# Altium schematic sheet Amps.SchDoc (part 1 of 2) (continued)
## Parts (continued)
C132  value 100nF  [CAPC0603(1608)100_L]  (hidden comment: Capacitor 100nF 0603)
C133  value 100nF  [CAPC0603(1608)100_L]  (hidden comment: Capacitor 100nF 0603)
C134  value 2.2uF  [CAPC0603(1608)100_L]  (hidden comment: Capacitor 2.2uF 0603)
C135  value 2.7nF  [CAPC0603(1608)100_L]  (hidden comment: Capacitor 2.7nF 0603)
C136  value 2.7nF  [CAPC0603(1608)100_L]  (hidden comment: Capacitor 2.7nF 0603)
C137  value 2.7nF  [CAPC0603(1608)100_L]  (hidden comment: Capacitor 2.7nF 0603)
C138  value 2.7nF  [CAPC0603(1608)100_L]  (hidden comment: Capacitor 2.7nF 0603)
C139  value 10µF  [CAPC0805(2012)145_L]  (hidden comment: Capacitor 10µF +/-20% 25V 0805)
C140  value 10µF  [CAPC0805(2012)145_L]  (hidden comment: Capacitor 10µF +/-20% 25V 0805)
C141  value 10µF  [CAPC0805(2012)145_L]  (hidden comment: Capacitor 10µF +/-20% 25V 0805)
C142  value 10µF  [CAPC0805(2012)145_L]  (hidden comment: Capacitor 10µF +/-20% 25V 0805)
C143  value 10µF  [CAPC0805(2012)145_L]  (hidden comment: Capacitor 10µF +/-20% 25V 0805)
C144  value 10µF  [CAPC0805(2012)145_L]  (hidden comment: Capacitor 10µF +/-20% 25V 0805)
C145  value 10µF  [CAPC0805(2012)145_L]  (hidden comment: Capacitor 10µF +/-20% 25V 0805)
C146  value 10µF  [CAPC0805(2012)145_L]  (hidden comment: Capacitor 10µF +/-20% 25V 0805)
C147  value 47nF  [CAPC0603(1608)100_L]  (hidden comment: Capacitor 47nF 0603)
C148  value 47nF  [CAPC0603(1608)100_L]  (hidden comment: Capacitor 47nF 0603)
C149  value 47nF  [CAPC0603(1608)100_L]  (hidden comment: Capacitor 47nF 0603)
C150  value 47nF  [CAPC0603(1608)100_L]  (hidden comment: Capacitor 47nF 0603)
C151  value 47nF  [CAPC0603(1608)100_L]  (hidden comment: Capacitor 47nF 0603)
C152  value 47nF  [CAPC0603(1608)100_L]  (hidden comment: Capacitor 47nF 0603)
C153  value 47nF  [CAPC0603(1608)100_L]  (hidden comment: Capacitor 47nF 0603)
C154  value 47nF  [CAPC0603(1608)100_L]  (hidden comment: Capacitor 47nF 0603)
C155  value 2.2uF  [CAPC0603(1608)100_L]  (hidden comment: Capacitor 2.2uF 0603)
C156  value 100nF  [CAPC0603(1608)100_L]  (hidden comment: Capacitor 100nF 0603)
C157  value 100nF  [CAPC0603(1608)100_L]  (hidden comment: Capacitor 100nF 0603)
C158  value 2.2uF  [CAPC0603(1608)100_L]  (hidden comment: Capacitor 2.2uF 0603)
C159  value 2.7nF  [CAPC0603(1608)100_L]  (hidden comment: Capacitor 2.7nF 0603)
C160  value 2.7nF  [CAPC0603(1608)100_L]  (hidden comment: Capacitor 2.7nF 0603)
C161  value 2.7nF  [CAPC0603(1608)100_L]  (hidden comment: Capacitor 2.7nF 0603)
C162  value 2.7nF  [CAPC0603(1608)100_L]  (hidden comment: Capacitor 2.7nF 0603)
C163  value 10µF  [CAPC0805(2012)145_L]  (hidden comment: Capacitor 10µF +/-20% 25V 0805)
C164  value 10µF  [CAPC0805(2012)145_L]  (hidden comment: Capacitor 10µF +/-20% 25V 0805)
C165  value 10µF  [CAPC0805(2012)145_L]  (hidden comment: Capacitor 10µF +/-20% 25V 0805)
C166  value 10µF  [CAPC0805(2012)145_L]  (hidden comment: Capacitor 10µF +/-20% 25V 0805)
C167  value 10µF  [CAPC0805(2012)145_L]  (hidden comment: Capacitor 10µF +/-20% 25V 0805)
C168  value 10µF  [CAPC0805(2012)145_L]  (hidden comment: Capacitor 10µF +/-20% 25V 0805)
C169  value 10µF  [CAPC0805(2012)145_L]  (hidden comment: Capacitor 10µF +/-20% 25V 0805)
C170  value 10µF  [CAPC0805(2012)145_L]  (hidden comment: Capacitor 10µF +/-20% 25V 0805)
C171  value 47nF  [CAPC0603(1608)100_L]  (hidden comment: Capacitor 47nF 0603)
C172  value 47nF  [CAPC0603(1608)100_L]  (hidden comment: Capacitor 47nF 0603)
C173  value 47nF  [CAPC0603(1608)100_L]  (hidden comment: Capacitor 47nF 0603)
C174  value 47nF  [CAPC0603(1608)100_L]  (hidden comment: Capacitor 47nF 0603)
C175  value 47nF  [CAPC0603(1608)100_L]  (hidden comment: Capacitor 47nF 0603)
C176  value 47nF  [CAPC0603(1608)100_L]  (hidden comment: Capacitor 47nF 0603)
C177  value 47nF  [CAPC0603(1608)100_L]  (hidden comment: Capacitor 47nF 0603)
C178  value 47nF  [CAPC0603(1608)100_L]  (hidden comment: Capacitor 47nF 0603)
C179  value 2.2uF  [CAPC0603(1608)100_L]  (hidden comment: Capacitor 2.2uF 0603)
C180  value 100nF  [CAPC0603(1608)100_L]  (hidden comment: Capacitor 100nF 0603)
C181  value 100nF  [CAPC0603(1608)100_L]  (hidden comment: Capacitor 100nF 0603)
C182  value 2.2uF  [CAPC0603(1608)100_L]  (hidden comment: Capacitor 2.2uF 0603)
C183  value 2.7nF  [CAPC0603(1608)100_L]  (hidden comment: Capacitor 2.7nF 0603)
C184  value 2.7nF  [CAPC0603(1608)100_L]  (hidden comment: Capacitor 2.7nF 0603)
C185  value 2.7nF  [CAPC0603(1608)100_L]  (hidden comment: Capacitor 2.7nF 0603)
C186  value 2.7nF  [CAPC0603(1608)100_L]  (hidden comment: Capacitor 2.7nF 0603)
C187  value 10µF  [CAPC0805(2012)145_L]  (hidden comment: Capacitor 10µF +/-20% 25V 0805)
C188  value 10µF  [CAPC0805(2012)145_L]  (hidden comment: Capacitor 10µF +/-20% 25V 0805)
C189  value 10µF  [CAPC0805(2012)145_L]  (hidden comment: Capacitor 10µF +/-20% 25V 0805)
C190  value 10µF  [CAPC0805(2012)145_L]  (hidden comment: Capacitor 10µF +/-20% 25V 0805)
C191  value 10µF  [CAPC0805(2012)145_L]  (hidden comment: Capacitor 10µF +/-20% 25V 0805)
C192  value 10µF  [CAPC0805(2012)145_L]  (hidden comment: Capacitor 10µF +/-20% 25V 0805)
C193  value 10µF  [CAPC0805(2012)145_L]  (hidden comment: Capacitor 10µF +/-20% 25V 0805)
C194  value 10µF  [CAPC0805(2012)145_L]  (hidden comment: Capacitor 10µF +/-20% 25V 0805)
C195  value 47nF  [CAPC0603(1608)100_L]  (hidden comment: Capacitor 47nF 0603)
C196  value 47nF  [CAPC0603(1608)100_L]  (hidden comment: Capacitor 47nF 0603)
C197  value 47nF  [CAPC0603(1608)100_L]  (hidden comment: Capacitor 47nF 0603)
C198  value 47nF  [CAPC0603(1608)100_L]  (hidden comment: Capacitor 47nF 0603)
C199  value 47nF  [CAPC0603(1608)100_L]  (hidden comment: Capacitor 47nF 0603)
C200  value 47nF  [CAPC0603(1608)100_L]  (hidden comment: Capacitor 47nF 0603)
C201  value 47nF  [CAPC0603(1608)100_L]  (hidden comment: Capacitor 47nF 0603)
C202  value 47nF  [CAPC0603(1608)100_L]  (hidden comment: Capacitor 47nF 0603)
C203  value 2.2uF  [CAPC0603(1608)100_L]  (hidden comment: Capacitor 2.2uF 0603)
C204  value 100nF  [CAPC0603(1608)100_L]  (hidden comment: Capacitor 100nF 0603)
C205  value 100nF  [CAPC0603(1608)100_L]  (hidden comment: Capacitor 100nF 0603)
C206  value 2.2uF  [CAPC0603(1608)100_L]  (hidden comment: Capacitor 2.2uF 0603)
C207  value 2.7nF  [CAPC0603(1608)100_L]  (hidden comment: Capacitor 2.7nF 0603)
C208  value 2.7nF  [CAPC0603(1608)100_L]  (hidden comment: Capacitor 2.7nF 0603)
C209  value 2.7nF  [CAPC0603(1608)100_L]  (hidden comment: Capacitor 2.7nF 0603)
C210  value 2.7nF  [CAPC0603(1608)100_L]  (hidden comment: Capacitor 2.7nF 0603)
C211  value 10µF  [CAPC0805(2012)145_L]  (hidden comment: Capacitor 10µF +/-20% 25V 0805)
C212  value 10µF  [CAPC0805(2012)145_L]  (hidden comment: Capacitor 10µF +/-20% 25V 0805)
C213  value 10µF  [CAPC0805(2012)145_L]  (hidden comment: Capacitor 10µF +/-20% 25V 0805)
C214  value 10µF  [CAPC0805(2012)145_L]  (hidden comment: Capacitor 10µF +/-20% 25V 0805)
C215  value 10µF  [CAPC0805(2012)145_L]  (hidden comment: Capacitor 10µF +/-20% 25V 0805)
C216  value 10µF  [CAPC0805(2012)145_L]  (hidden comment: Capacitor 10µF +/-20% 25V 0805)
C217  value 10µF  [CAPC0805(2012)145_L]  (hidden comment: Capacitor 10µF +/-20% 25V 0805)
C218  value 10µF  [CAPC0805(2012)145_L]  (hidden comment: Capacitor 10µF +/-20% 25V 0805)
C219  value 47nF  [CAPC0603(1608)100_L]  (hidden comment: Capacitor 47nF 0603)
C220  value 47nF  [CAPC0603(1608)100_L]  (hidden comment: Capacitor 47nF 0603)
C221  value 47nF  [CAPC0603(1608)100_L]  (hidden comment: Capacitor 47nF 0603)
C222  value 47nF  [CAPC0603(1608)100_L]  (hidden comment: Capacitor 47nF 0603)
C223  value 47nF  [CAPC0603(1608)100_L]  (hidden comment: Capacitor 47nF 0603)
C224  value 47nF  [CAPC0603(1608)100_L]  (hidden comment: Capacitor 47nF 0603)
C225  value 47nF  [CAPC0603(1608)100_L]  (hidden comment: Capacitor 47nF 0603)
C226  value 47nF  [CAPC0603(1608)100_L]  (hidden comment: Capacitor 47nF 0603)
C227  value 2.2uF  [CAPC0603(1608)100_L]  (hidden comment: Capacitor 2.2uF 0603)
C228  value 100nF  [CAPC0603(1608)100_L]  (hidden comment: Capacitor 100nF 0603)
C229  value 100nF  [CAPC0603(1608)100_L]  (hidden comment: Capacitor 100nF 0603)
C230  value 2.2uF  [CAPC0603(1608)100_L]  (hidden comment: Capacitor 2.2uF 0603)
D1  1N4007  [FAIR-DO-41-2]
D2  1N4007  [FAIR-DO-41-2]
D3  1N4007  [FAIR-DO-41-2]
D4  1N4007  [FAIR-DO-41-2]
D5  1N4007  [FAIR-DO-41-2]
D6  1N4007  [FAIR-DO-41-2]
D7  1N4007  [FAIR-DO-41-2]
D8  1N4007  [FAIR-DO-41-2]
D9  1N4007  [FAIR-DO-41-2]
D10  1N4007  [FAIR-DO-41-2]
D11  1N4007  [FAIR-DO-41-2]
D12  1N4007  [FAIR-DO-41-2]
D13  1N4007  [FAIR-DO-41-2]
D14  1N4007  [FAIR-DO-41-2]
D15  1N4007  [FAIR-DO-41-2]
D16  1N4007  [FAIR-DO-41-2]
D17  1N4007  [FAIR-DO-41-2]
D18  1N4007  [FAIR-DO-41-2]
D19  1N4007  [FAIR-DO-41-2]
D20  1N4007  [FAIR-DO-41-2]
D21  1N4007  [FAIR-DO-41-2]
D22  1N4007  [FAIR-DO-41-2]
D23  1N4007  [FAIR-DO-41-2]
D24  1N4007  [FAIR-DO-41-2]
D25  1N4007  [FAIR-DO-41-2]
D26  1N4007  [FAIR-DO-41-2]
D27  1N4007  [FAIR-DO-41-2]
D28  1N4007  [FAIR-DO-41-2]
D29  1N4007  [FAIR-DO-41-2]
D30  1N4007  [FAIR-DO-41-2]
D31  1N4007  [FAIR-DO-41-2]
D32  1N4007  [FAIR-DO-41-2]
D33  1N4007  [FAIR-DO-41-2]
D34  1N4007  [FAIR-DO-41-2]
D35  1N4007  [FAIR-DO-41-2]
D36  1N4007  [FAIR-DO-41-2]
D37  1N4007  [FAIR-DO-41-2]
D38  1N4007  [FAIR-DO-41-2]
D39  1N4007  [FAIR-DO-41-2]
D40  1N4007  [FAIR-DO-41-2]
D41  1N4007  [FAIR-DO-41-2]
D42  1N4007  [FAIR-DO-41-2]
D43  1N4007  [FAIR-DO-41-2]
D44  1N4007  [FAIR-DO-41-2]
D45  1N4007  [FAIR-DO-41-2]
D46  1N4007  [FAIR-DO-41-2]
D47  1N4007  [FAIR-DO-41-2]
D48  1N4007  [FAIR-DO-41-2]
D49  1N4007  [FAIR-DO-41-2]
D50  1N4007  [FAIR-DO-41-2]
D51  1N4007  [FAIR-DO-41-2]
D52  1N4007  [FAIR-DO-41-2]
D53  1N4007  [FAIR-DO-41-2]
D54  1N4007  [FAIR-DO-41-2]
D55  1N4007  [FAIR-DO-41-2]
D56  1N4007  [FAIR-DO-41-2]
D57  1N4007  [FAIR-DO-41-2]
D58  1N4007  [FAIR-DO-41-2]
D59  1N4007  [FAIR-DO-41-2]
D60  1N4007  [FAIR-DO-41-2]
D61  1N4007  [FAIR-DO-41-2]
D62  1N4007  [FAIR-DO-41-2]
D63  1N4007  [FAIR-DO-41-2]
D64  1N4007  [FAIR-DO-41-2]
Q3  S9013  [JSCJ-TO-92-3_V]
Q4  S8550  [UNIC-TO-92-3]
Q5  S9013  [JSCJ-TO-92-3_V]
Q6  S8550  [UNIC-TO-92-3]
Q7  S9013  [JSCJ-TO-92-3_V]
Q8  S8550  [UNIC-TO-92-3]
Q9  S9013  [JSCJ-TO-92-3_V]
Q10  S8550  [UNIC-TO-92-3]
Q11  S9013  [JSCJ-TO-92-3_V]
Q12  S8550  [UNIC-TO-92-3]
Q13  S9013  [JSCJ-TO-92-3_V]
Q14  S8550  [UNIC-TO-92-3]
Q15  S9013  [JSCJ-TO-92-3_V]
Q16  S8550  [UNIC-TO-92-3]
Q17  S9013  [JSCJ-TO-92-3_V]
Q18  S8550  [UNIC-TO-92-3]
Q19  S9013  [JSCJ-TO-92-3_V]
Q20  S8550  [UNIC-TO-92-3]
Q21  S9013  [JSCJ-TO-92-3_V]
Q22  S8550  [UNIC-TO-92-3]
Q23  S9013  [JSCJ-TO-92-3_V]
Q24  S8550  [UNIC-TO-92-3]
Q25  S9013  [JSCJ-TO-92-3_V]
Q26  S8550  [UNIC-TO-92-3]
Q27  S9013  [JSCJ-TO-92-3_V]
Q28  S8550  [UNIC-TO-92-3]
Q29  S9013  [JSCJ-TO-92-3_V]
Q30  S8550  [UNIC-TO-92-3]
Q31  S9013  [JSCJ-TO-92-3_V]
Q32  S8550  [UNIC-TO-92-3]
Q33  S9013  [JSCJ-TO-92-3_V]
Q34  S8550  [UNIC-TO-92-3]
Q35  S9013  [JSCJ-TO-92-3_V]
Q36  S8550  [UNIC-TO-92-3]
Q37  S9013  [JSCJ-TO-92-3_V]
Q38  S8550  [UNIC-TO-92-3]
Q39  S9013  [JSCJ-TO-92-3_V]
Q40  S8550  [UNIC-TO-92-3]
Q41  S9013  [JSCJ-TO-92-3_V]
Q42  S8550  [UNIC-TO-92-3]
Q43  S9013  [JSCJ-TO-92-3_V]
Q44  S8550  [UNIC-TO-92-3]
Q45  S9013  [JSCJ-TO-92-3_V]
Q46  S8550  [UNIC-TO-92-3]
Q47  S9013  [JSCJ-TO-92-3_V]
Q48  S8550  [UNIC-TO-92-3]
Q49  S9013  [JSCJ-TO-92-3_V]
Q50  S8550  [UNIC-TO-92-3]
Q51  S9013  [JSCJ-TO-92-3_V]
Q52  S8550  [UNIC-TO-92-3]
Q53  S9013  [JSCJ-TO-92-3_V]
Q54  S8550  [UNIC-TO-92-3]
Q55  S9013  [JSCJ-TO-92-3_V]
Q56  S8550  [UNIC-TO-92-3]
Q57  S9013  [JSCJ-TO-92-3_V]
Q58  S8550  [UNIC-TO-92-3]
Q59  S9013  [JSCJ-TO-92-3_V]
Q60  S8550  [UNIC-TO-92-3]
Q61  S9013  [JSCJ-TO-92-3_V]
Q62  S8550  [UNIC-TO-92-3]
Q63  S9013  [JSCJ-TO-92-3_V]
Q64  S8550  [UNIC-TO-92-3]
Q65  S9013  [JSCJ-TO-92-3_V]
Q66  S8550  [UNIC-TO-92-3]
R25  237  [RESC0603(1608)_L]
R26  237  [RESC0603(1608)_L]
R27  237  [RESC0603(1608)_L]
R28  237  [RESC0603(1608)_L]
R29  237  [RESC0603(1608)_L]
R30  237  [RESC0603(1608)_L]
R31  237  [RESC0603(1608)_L]
R32  237  [RESC0603(1608)_L]
R33  value 49.9k  [RESC0603(1608)_L]  (hidden comment: 49.9k Ohm 0603)
R34  value 49.9k  [RESC0603(1608)_L]  (hidden comment: 49.9k Ohm 0603)
R35  value 49.9k  [RESC0603(1608)_L]  (hidden comment: 49.9k Ohm 0603)
R36  value 49.9k  [RESC0603(1608)_L]  (hidden comment: 49.9k Ohm 0603)
R37  value 49.9k  [RESC0603(1608)_L]  (hidden comment: 49.9k Ohm 0603)
R38  value 49.9k  [RESC0603(1608)_L]  (hidden comment: 49.9k Ohm 0603)
R39  value 49.9k  [RESC0603(1608)_L]  (hidden comment: 49.9k Ohm 0603)
R40  value 49.9k  [RESC0603(1608)_L]  (hidden comment: 49.9k Ohm 0603)
R41  value 6.6k  [RESC0603(1608)_L]  (hidden comment: 6.6k 0603)
R42  value 6.6k  [RESC0603(1608)_L]  (hidden comment: 6.6k 0603)
R43  value 6.6k  [RESC0603(1608)_L]  (hidden comment: 6.6k 0603)
R44  value 6.6k  [RESC0603(1608)_L]  (hidden comment: 6.6k 0603)
R45  value 6.6k  [RESC0603(1608)_L]  (hidden comment: 6.6k 0603)
R46  value 6.6k  [RESC0603(1608)_L]  (hidden comment: 6.6k 0603)
R47  value 6.6k  [RESC0603(1608)_L]  (hidden comment: 6.6k 0603)
R48  value 6.6k  [RESC0603(1608)_L]  (hidden comment: 6.6k 0603)
R49  value 1k  [RESC0603(1608)_L]  (hidden comment: 1k 0603)
R50  value 1k  [RESC0603(1608)_L]  (hidden comment: 1k 0603)
R51  value 1k  [RESC0603(1608)_L]  (hidden comment: 1k 0603)
R52  value 1k  [RESC0603(1608)_L]  (hidden comment: 1k 0603)
R53  value 2k  [RESC0603(1608)_L]  (hidden comment: 2k 0603)
R54  value 2k  [RESC0603(1608)_L]  (hidden comment: 2k 0603)
R55  value 2k  [RESC0603(1608)_L]  (hidden comment: 2k 0603)
R56  value 2k  [RESC0603(1608)_L]  (hidden comment: 2k 0603)
R57  value 1k  [RESC0603(1608)_L]  (hidden comment: 1k 0603)
R58  value 1k  [RESC0603(1608)_L]  (hidden comment: 1k 0603)
R59  value 1k  [RESC0603(1608)_L]  (hidden comment: 1k 0603)
R60  value 1k  [RESC0603(1608)_L]  (hidden comment: 1k 0603)
R61  value 2k  [RESC0603(1608)_L]  (hidden comment: 2k 0603)
R62  value 2k  [RESC0603(1608)_L]  (hidden comment: 2k 0603)
R63  value 2k  [RESC0603(1608)_L]  (hidden comment: 2k 0603)
R64  value 2k  [RESC0603(1608)_L]  (hidden comment: 2k 0603)
R65  value 560  [RESC0603(1608)_L]  (hidden comment: 560 0603)
R66  value 560  [RESC0603(1608)_L]  (hidden comment: 560 0603)
R67  value 560  [RESC0603(1608)_L]  (hidden comment: 560 0603)
R68  value 560  [RESC0603(1608)_L]  (hidden comment: 560 0603)
R69  value 560  [RESC0603(1608)_L]  (hidden comment: 560 0603)
R70  value 560  [RESC0603(1608)_L]  (hidden comment: 560 0603)
R71  value 560  [RESC0603(1608)_L]  (hidden comment: 560 0603)
R72  value 560  [RESC0603(1608)_L]  (hidden comment: 560 0603)
R73  237  [RESC0603(1608)_L]
R74  237  [RESC0603(1608)_L]
R75  237  [RESC0603(1608)_L]
R76  237  [RESC0603(1608)_L]
R77  237  [RESC0603(1608)_L]
R78  237  [RESC0603(1608)_L]
R79  237  [RESC0603(1608)_L]
R80  237  [RESC0603(1608)_L]
R81  value 49.9k  [RESC0603(1608)_L]  (hidden comment: 49.9k Ohm 0603)
R82  value 49.9k  [RESC0603(1608)_L]  (hidden comment: 49.9k Ohm 0603)
R83  value 49.9k  [RESC0603(1608)_L]  (hidden comment: 49.9k Ohm 0603)
R84  value 49.9k  [RESC0603(1608)_L]  (hidden comment: 49.9k Ohm 0603)
R85  value 49.9k  [RESC0603(1608)_L]  (hidden comment: 49.9k Ohm 0603)
R86  value 49.9k  [RESC0603(1608)_L]  (hidden comment: 49.9k Ohm 0603)
R87  value 49.9k  [RESC0603(1608)_L]  (hidden comment: 49.9k Ohm 0603)
R88  value 49.9k  [RESC0603(1608)_L]  (hidden comment: 49.9k Ohm 0603)
R89  value 6.6k  [RESC0603(1608)_L]  (hidden comment: 6.6k 0603)
R90  value 6.6k  [RESC0603(1608)_L]  (hidden comment: 6.6k 0603)
R91  value 6.6k  [RESC0603(1608)_L]  (hidden comment: 6.6k 0603)
R92  value 6.6k  [RESC0603(1608)_L]  (hidden comment: 6.6k 0603)
R93  value 6.6k  [RESC0603(1608)_L]  (hidden comment: 6.6k 0603)
R94  value 6.6k  [RESC0603(1608)_L]  (hidden comment: 6.6k 0603)
R95  value 6.6k  [RESC0603(1608)_L]  (hidden comment: 6.6k 0603)
R96  value 6.6k  [RESC0603(1608)_L]  (hidden comment: 6.6k 0603)
R97  value 1k  [RESC0603(1608)_L]  (hidden comment: 1k 0603)
R98  value 1k  [RESC0603(1608)_L]  (hidden comment: 1k 0603)
R99  value 1k  [RESC0603(1608)_L]  (hidden comment: 1k 0603)
R100  value 1k  [RESC0603(1608)_L]  (hidden comment: 1k 0603)
R101  value 2k  [RESC0603(1608)_L]  (hidden comment: 2k 0603)
R102  value 2k  [RESC0603(1608)_L]  (hidden comment: 2k 0603)
R103  value 2k  [RESC0603(1608)_L]  (hidden comment: 2k 0603)
R104  value 2k  [RESC0603(1608)_L]  (hidden comment: 2k 0603)
R105  value 1k  [RESC0603(1608)_L]  (hidden comment: 1k 0603)
R106  value 1k  [RESC0603(1608)_L]  (hidden comment: 1k 0603)
R107  value 1k  [RESC0603(1608)_L]  (hidden comment: 1k 0603)
R108  value 1k  [RESC0603(1608)_L]  (hidden comment: 1k 0603)
R109  value 2k  [RESC0603(1608)_L]  (hidden comment: 2k 0603)
R110  value 2k  [RESC0603(1608)_L]  (hidden comment: 2k 0603)
R111  value 2k  [RESC0603(1608)_L]  (hidden comment: 2k 0603)
R112  value 2k  [RESC0603(1608)_L]  (hidden comment: 2k 0603)
R113  value 560  [RESC0603(1608)_L]  (hidden comment: 560 0603)
R114  value 560  [RESC0603(1608)_L]  (hidden comment: 560 0603)
R115  value 560  [RESC0603(1608)_L]  (hidden comment: 560 0603)
R116  value 560  [RESC0603(1608)_L]  (hidden comment: 560 0603)
R117  value 560  [RESC0603(1608)_L]  (hidden comment: 560 0603)
R118  value 560  [RESC0603(1608)_L]  (hidden comment: 560 0603)
R119  value 560  [RESC0603(1608)_L]  (hidden comment: 560 0603)
R120  value 560  [RESC0603(1608)_L]  (hidden comment: 560 0603)
R121  237  [RESC0603(1608)_L]
R122  237  [RESC0603(1608)_L]
R123  237  [RESC0603(1608)_L]
R124  237  [RESC0603(1608)_L]
R125  237  [RESC0603(1608)_L]
R126  237  [RESC0603(1608)_L]
R127  237  [RESC0603(1608)_L]
R128  237  [RESC0603(1608)_L]
R129  value 49.9k  [RESC0603(1608)_L]  (hidden comment: 49.9k Ohm 0603)
R130  value 49.9k  [RESC0603(1608)_L]  (hidden comment: 49.9k Ohm 0603)
R131  value 49.9k  [RESC0603(1608)_L]  (hidden comment: 49.9k Ohm 0603)
R132  value 49.9k  [RESC0603(1608)_L]  (hidden comment: 49.9k Ohm 0603)
R133  value 49.9k  [RESC0603(1608)_L]  (hidden comment: 49.9k Ohm 0603)
R134  value 49.9k  [RESC0603(1608)_L]  (hidden comment: 49.9k Ohm 0603)
R135  value 49.9k  [RESC0603(1608)_L]  (hidden comment: 49.9k Ohm 0603)
R136  value 49.9k  [RESC0603(1608)_L]  (hidden comment: 49.9k Ohm 0603)
R137  value 6.6k  [RESC0603(1608)_L]  (hidden comment: 6.6k 0603)
R138  value 6.6k  [RESC0603(1608)_L]  (hidden comment: 6.6k 0603)
R139  value 6.6k  [RESC0603(1608)_L]  (hidden comment: 6.6k 0603)
R140  value 6.6k  [RESC0603(1608)_L]  (hidden comment: 6.6k 0603)
R141  value 6.6k  [RESC0603(1608)_L]  (hidden comment: 6.6k 0603)
R142  value 6.6k  [RESC0603(1608)_L]  (hidden comment: 6.6k 0603)
R143  value 6.6k  [RESC0603(1608)_L]  (hidden comment: 6.6k 0603)
R144  value 6.6k  [RESC0603(1608)_L]  (hidden comment: 6.6k 0603)
R145  value 1k  [RESC0603(1608)_L]  (hidden comment: 1k 0603)
R146  value 1k  [RESC0603(1608)_L]  (hidden comment: 1k 0603)
R147  value 1k  [RESC0603(1608)_L]  (hidden comment: 1k 0603)
R148  value 1k  [RESC0603(1608)_L]  (hidden comment: 1k 0603)
R149  value 2k  [RESC0603(1608)_L]  (hidden comment: 2k 0603)
R150  value 2k  [RESC0603(1608)_L]  (hidden comment: 2k 0603)
R151  value 2k  [RESC0603(1608)_L]  (hidden comment: 2k 0603)
R152  value 2k  [RESC0603(1608)_L]  (hidden comment: 2k 0603)
R153  value 1k  [RESC0603(1608)_L]  (hidden comment: 1k 0603)
R154  value 1k  [RESC0603(1608)_L]  (hidden comment: 1k 0603)
R155  value 1k  [RESC0603(1608)_L]  (hidden comment: 1k 0603)
R156  value 1k  [RESC0603(1608)_L]  (hidden comment: 1k 0603)
R157  value 2k  [RESC0603(1608)_L]  (hidden comment: 2k 0603)
R158  value 2k  [RESC0603(1608)_L]  (hidden comment: 2k 0603)
R159  value 2k  [RESC0603(1608)_L]  (hidden comment: 2k 0603)
R160  value 2k  [RESC0603(1608)_L]  (hidden comment: 2k 0603)
R161  value 560  [RESC0603(1608)_L]  (hidden comment: 560 0603)
R162  value 560  [RESC0603(1608)_L]  (hidden comment: 560 0603)
R163  value 560  [RESC0603(1608)_L]  (hidden comment: 560 0603)
R164  value 560  [RESC0603(1608)_L]  (hidden comment: 560 0603)
R165  value 560  [RESC0603(1608)_L]  (hidden comment: 560 0603)
R166  value 560  [RESC0603(1608)_L]  (hidden comment: 560 0603)
R167  value 560  [RESC0603(1608)_L]  (hidden comment: 560 0603)
R168  value 560  [RESC0603(1608)_L]  (hidden comment: 560 0603)
R169  237  [RESC0603(1608)_L]
R170  237  [RESC0603(1608)_L]
R171  237  [RESC0603(1608)_L]
R172  237  [RESC0603(1608)_L]
R173  237  [RESC0603(1608)_L]
R174  237  [RESC0603(1608)_L]
R175  237  [RESC0603(1608)_L]
R176  237  [RESC0603(1608)_L]
R177  value 49.9k  [RESC0603(1608)_L]  (hidden comment: 49.9k Ohm 0603)
R178  value 49.9k  [RESC0603(1608)_L]  (hidden comment: 49.9k Ohm 0603)
R179  value 49.9k  [RESC0603(1608)_L]  (hidden comment: 49.9k Ohm 0603)
R180  value 49.9k  [RESC0603(1608)_L]  (hidden comment: 49.9k Ohm 0603)
R181  value 49.9k  [RESC0603(1608)_L]  (hidden comment: 49.9k Ohm 0603)
R182  value 49.9k  [RESC0603(1608)_L]  (hidden comment: 49.9k Ohm 0603)
R183  value 49.9k  [RESC0603(1608)_L]  (hidden comment: 49.9k Ohm 0603)
R184  value 49.9k  [RESC0603(1608)_L]  (hidden comment: 49.9k Ohm 0603)
R185  value 6.6k  [RESC0603(1608)_L]  (hidden comment: 6.6k 0603)
R186  value 6.6k  [RESC0603(1608)_L]  (hidden comment: 6.6k 0603)
R187  value 6.6k  [RESC0603(1608)_L]  (hidden comment: 6.6k 0603)
R188  value 6.6k  [RESC0603(1608)_L]  (hidden comment: 6.6k 0603)
R189  value 6.6k  [RESC0603(1608)_L]  (hidden comment: 6.6k 0603)
R190  value 6.6k  [RESC0603(1608)_L]  (hidden comment: 6.6k 0603)
R191  value 6.6k  [RESC0603(1608)_L]  (hidden comment: 6.6k 0603)
R192  value 6.6k  [RESC0603(1608)_L]  (hidden comment: 6.6k 0603)
R193  value 1k  [RESC0603(1608)_L]  (hidden comment: 1k 0603)
R194  value 1k  [RESC0603(1608)_L]  (hidden comment: 1k 0603)
R195  value 1k  [RESC0603(1608)_L]  (hidden comment: 1k 0603)
R196  value 1k  [RESC0603(1608)_L]  (hidden comment: 1k 0603)
R197  value 2k  [RESC0603(1608)_L]  (hidden comment: 2k 0603)
R198  value 2k  [RESC0603(1608)_L]  (hidden comment: 2k 0603)
R199  value 2k  [RESC0603(1608)_L]  (hidden comment: 2k 0603)
R200  value 2k  [RESC0603(1608)_L]  (hidden comment: 2k 0603)
R201  value 1k  [RESC0603(1608)_L]  (hidden comment: 1k 0603)
R202  value 1k  [RESC0603(1608)_L]  (hidden comment: 1k 0603)
R203  value 1k  [RESC0603(1608)_L]  (hidden comment: 1k 0603)
R204  value 1k  [RESC0603(1608)_L]  (hidden comment: 1k 0603)
R205  value 2k  [RESC0603(1608)_L]  (hidden comment: 2k 0603)
R206  value 2k  [RESC0603(1608)_L]  (hidden comment: 2k 0603)
R207  value 2k  [RESC0603(1608)_L]  (hidden comment: 2k 0603)
R208  value 2k  [RESC0603(1608)_L]  (hidden comment: 2k 0603)
R209  value 560  [RESC0603(1608)_L]  (hidden comment: 560 0603)
R210  value 560  [RESC0603(1608)_L]  (hidden comment: 560 0603)
R211  value 560  [RESC0603(1608)_L]  (hidden comment: 560 0603)
R212  value 560  [RESC0603(1608)_L]  (hidden comment: 560 0603)
R213  value 560  [RESC0603(1608)_L]  (hidden comment: 560 0603)
R214  value 560  [RESC0603(1608)_L]  (hidden comment: 560 0603)
R215  value 560  [RESC0603(1608)_L]  (hidden comment: 560 0603)
R216  value 560  [RESC0603(1608)_L]  (hidden comment: 560 0603)
R217  237  [RESC0603(1608)_L]
R218  237  [RESC0603(1608)_L]
R219  237  [RESC0603(1608)_L]
R220  237  [RESC0603(1608)_L]
R221  237  [RESC0603(1608)_L]
R222  237  [RESC0603(1608)_L]
R223  237  [RESC0603(1608)_L]
R224  237  [RESC0603(1608)_L]
R225  value 49.9k  [RESC0603(1608)_L]  (hidden comment: 49.9k Ohm 0603)
R226  value 49.9k  [RESC0603(1608)_L]  (hidden comment: 49.9k Ohm 0603)
R227  value 49.9k  [RESC0603(1608)_L]  (hidden comment: 49.9k Ohm 0603)
R228  value 49.9k  [RESC0603(1608)_L]  (hidden comment: 49.9k Ohm 0603)
R229  value 49.9k  [RESC0603(1608)_L]  (hidden comment: 49.9k Ohm 0603)
R230  value 49.9k  [RESC0603(1608)_L]  (hidden comment: 49.9k Ohm 0603)
R231  value 49.9k  [RESC0603(1608)_L]  (hidden comment: 49.9k Ohm 0603)
R232  value 49.9k  [RESC0603(1608)_L]  (hidden comment: 49.9k Ohm 0603)
R233  value 6.6k  [RESC0603(1608)_L]  (hidden comment: 6.6k 0603)
R234  value 6.6k  [RESC0603(1608)_L]  (hidden comment: 6.6k 0603)
R235  value 6.6k  [RESC0603(1608)_L]  (hidden comment: 6.6k 0603)
R236  value 6.6k  [RESC0603(1608)_L]  (hidden comment: 6.6k 0603)
R237  value 6.6k  [RESC0603(1608)_L]  (hidden comment: 6.6k 0603)
R238  value 6.6k  [RESC0603(1608)_L]  (hidden comment: 6.6k 0603)
R239  value 6.6k  [RESC0603(1608)_L]  (hidden comment: 6.6k 0603)
R240  value 6.6k  [RESC0603(1608)_L]  (hidden comment: 6.6k 0603)
R241  value 1k  [RESC0603(1608)_L]  (hidden comment: 1k 0603)
R242  value 1k  [RESC0603(1608)_L]  (hidden comment: 1k 0603)
R243  value 1k  [RESC0603(1608)_L]  (hidden comment: 1k 0603)
R244  value 1k  [RESC0603(1608)_L]  (hidden comment: 1k 0603)
R245  value 2k  [RESC0603(1608)_L]  (hidden comment: 2k 0603)
R246  value 2k  [RESC0603(1608)_L]  (hidden comment: 2k 0603)
R247  value 2k  [RESC0603(1608)_L]  (hidden comment: 2k 0603)
R248  value 2k  [RESC0603(1608)_L]  (hidden comment: 2k 0603)
R249  value 1k  [RESC0603(1608)_L]  (hidden comment: 1k 0603)
R250  value 1k  [RESC0603(1608)_L]  (hidden comment: 1k 0603)
R251  value 1k  [RESC0603(1608)_L]  (hidden comment: 1k 0603)
R252  value 1k  [RESC0603(1608)_L]  (hidden comment: 1k 0603)
R253  value 2k  [RESC0603(1608)_L]  (hidden comment: 2k 0603)
R254  value 2k  [RESC0603(1608)_L]  (hidden comment: 2k 0603)
R255  value 2k  [RESC0603(1608)_L]  (hidden comment: 2k 0603)
R256  value 2k  [RESC0603(1608)_L]  (hidden comment: 2k 0603)
R257  value 560  [RESC0603(1608)_L]  (hidden comment: 560 0603)
R258  value 560  [RESC0603(1608)_L]  (hidden comment: 560 0603)
R259  value 560  [RESC0603(1608)_L]  (hidden comment: 560 0603)
R260  value 560  [RESC0603(1608)_L]  (hidden comment: 560 0603)
R261  value 560  [RESC0603(1608)_L]  (hidden comment: 560 0603)
R262  value 560  [RESC0603(1608)_L]  (hidden comment: 560 0603)
R263  value 560  [RESC0603(1608)_L]  (hidden comment: 560 0603)
R264  value 560  [RESC0603(1608)_L]  (hidden comment: 560 0603)
R265  237  [RESC0603(1608)_L]
R266  237  [RESC0603(1608)_L]
R267  237  [RESC0603(1608)_L]
R268  237  [RESC0603(1608)_L]
R269  237  [RESC0603(1608)_L]
R270  237  [RESC0603(1608)_L]
R271  237  [RESC0603(1608)_L]
R272  237  [RESC0603(1608)_L]
R273  value 49.9k  [RESC0603(1608)_L]  (hidden comment: 49.9k Ohm 0603)
R274  value 49.9k  [RESC0603(1608)_L]  (hidden comment: 49.9k Ohm 0603)
R275  value 49.9k  [RESC0603(1608)_L]  (hidden comment: 49.9k Ohm 0603)
R276  value 49.9k  [RESC0603(1608)_L]  (hidden comment: 49.9k Ohm 0603)
R277  value 49.9k  [RESC0603(1608)_L]  (hidden comment: 49.9k Ohm 0603)
R278  value 49.9k  [RESC0603(1608)_L]  (hidden comment: 49.9k Ohm 0603)
R279  value 49.9k  [RESC0603(1608)_L]  (hidden comment: 49.9k Ohm 0603)
R280  value 49.9k  [RESC0603(1608)_L]  (hidden comment: 49.9k Ohm 0603)
R281  value 6.6k  [RESC0603(1608)_L]  (hidden comment: 6.6k 0603)
R282  value 6.6k  [RESC0603(1608)_L]  (hidden comment: 6.6k 0603)
R283  value 6.6k  [RESC0603(1608)_L]  (hidden comment: 6.6k 0603)
R284  value 6.6k  [RESC0603(1608)_L]  (hidden comment: 6.6k 0603)
R285  value 6.6k  [RESC0603(1608)_L]  (hidden comment: 6.6k 0603)
R286  value 6.6k  [RESC0603(1608)_L]  (hidden comment: 6.6k 0603)
R287  value 6.6k  [RESC0603(1608)_L]  (hidden comment: 6.6k 0603)
R288  value 6.6k  [RESC0603(1608)_L]  (hidden comment: 6.6k 0603)
R289  value 1k  [RESC0603(1608)_L]  (hidden comment: 1k 0603)
R290  value 1k  [RESC0603(1608)_L]  (hidden comment: 1k 0603)
R291  value 1k  [RESC0603(1608)_L]  (hidden comment: 1k 0603)
R292  value 1k  [RESC0603(1608)_L]  (hidden comment: 1k 0603)
R293  value 2k  [RESC0603(1608)_L]  (hidden comment: 2k 0603)
R294  value 2k  [RESC0603(1608)_L]  (hidden comment: 2k 0603)
R295  value 2k  [RESC0603(1608)_L]  (hidden comment: 2k 0603)
R296  value 2k  [RESC0603(1608)_L]  (hidden comment: 2k 0603)
R297  value 1k  [RESC0603(1608)_L]  (hidden comment: 1k 0603)
R298  value 1k  [RESC0603(1608)_L]  (hidden comment: 1k 0603)
R299  value 1k  [RESC0603(1608)_L]  (hidden comment: 1k 0603)
R300  value 1k  [RESC0603(1608)_L]  (hidden comment: 1k 0603)
R301  value 2k  [RESC0603(1608)_L]  (hidden comment: 2k 0603)
R302  value 2k  [RESC0603(1608)_L]  (hidden comment: 2k 0603)
R303  value 2k  [RESC0603(1608)_L]  (hidden comment: 2k 0603)
R304  value 2k  [RESC0603(1608)_L]  (hidden comment: 2k 0603)
R305  value 560  [RESC0603(1608)_L]  (hidden comment: 560 0603)
R306  value 560  [RESC0603(1608)_L]  (hidden comment: 560 0603)
R307  value 560  [RESC0603(1608)_L]  (hidden comment: 560 0603)
R308  value 560  [RESC0603(1608)_L]  (hidden comment: 560 0603)
R309  value 560  [RESC0603(1608)_L]  (hidden comment: 560 0603)
R310  value 560  [RESC0603(1608)_L]  (hidden comment: 560 0603)
R311  value 560  [RESC0603(1608)_L]  (hidden comment: 560 0603)
R312  value 560  [RESC0603(1608)_L]  (hidden comment: 560 0603)
R313  237  [RESC0603(1608)_L]
R314  237  [RESC0603(1608)_L]
R315  237  [RESC0603(1608)_L]
R316  237  [RESC0603(1608)_L]
R317  237  [RESC0603(1608)_L]
R318  237  [RESC0603(1608)_L]
R319  237  [RESC0603(1608)_L]
R320  237  [RESC0603(1608)_L]
R321  value 49.9k  [RESC0603(1608)_L]  (hidden comment: 49.9k Ohm 0603)
R322  value 49.9k  [RESC0603(1608)_L]  (hidden comment: 49.9k Ohm 0603)
R323  value 49.9k  [RESC0603(1608)_L]  (hidden comment: 49.9k Ohm 0603)
R324  value 49.9k  [RESC0603(1608)_L]  (hidden comment: 49.9k Ohm 0603)
R325  value 49.9k  [RESC0603(1608)_L]  (hidden comment: 49.9k Ohm 0603)
R326  value 49.9k  [RESC0603(1608)_L]  (hidden comment: 49.9k Ohm 0603)
R327  value 49.9k  [RESC0603(1608)_L]  (hidden comment: 49.9k Ohm 0603)
R328  value 49.9k  [RESC0603(1608)_L]  (hidden comment: 49.9k Ohm 0603)
R329  value 6.6k  [RESC0603(1608)_L]  (hidden comment: 6.6k 0603)
R330  value 6.6k  [RESC0603(1608)_L]  (hidden comment: 6.6k 0603)
R331  value 6.6k  [RESC0603(1608)_L]  (hidden comment: 6.6k 0603)
R332  value 6.6k  [RESC0603(1608)_L]  (hidden comment: 6.6k 0603)
R333  value 6.6k  [RESC0603(1608)_L]  (hidden comment: 6.6k 0603)
R334  value 6.6k  [RESC0603(1608)_L]  (hidden comment: 6.6k 0603)
R335  value 6.6k  [RESC0603(1608)_L]  (hidden comment: 6.6k 0603)
R336  value 6.6k  [RESC0603(1608)_L]  (hidden comment: 6.6k 0603)
R337  value 1k  [RESC0603(1608)_L]  (hidden comment: 1k 0603)
R338  value 1k  [RESC0603(1608)_L]  (hidden comment: 1k 0603)
R339  value 1k  [RESC0603(1608)_L]  (hidden comment: 1k 0603)
R340  value 1k  [RESC0603(1608)_L]  (hidden comment: 1k 0603)
R341  value 2k  [RESC0603(1608)_L]  (hidden comment: 2k 0603)
R342  value 2k  [RESC0603(1608)_L]  (hidden comment: 2k 0603)
R343  value 2k  [RESC0603(1608)_L]  (hidden comment: 2k 0603)
R344  value 2k  [RESC0603(1608)_L]  (hidden comment: 2k 0603)
R345  value 1k  [RESC0603(1608)_L]  (hidden comment: 1k 0603)
R346  value 1k  [RESC0603(1608)_L]  (hidden comment: 1k 0603)
R347  value 1k  [RESC0603(1608)_L]  (hidden comment: 1k 0603)
R348  value 1k  [RESC0603(1608)_L]  (hidden comment: 1k 0603)
R349  value 2k  [RESC0603(1608)_L]  (hidden comment: 2k 0603)
R350  value 2k  [RESC0603(1608)_L]  (hidden comment: 2k 0603)
R351  value 2k  [RESC0603(1608)_L]  (hidden comment: 2k 0603)
R352  value 2k  [RESC0603(1608)_L]  (hidden comment: 2k 0603)
R353  value 560  [RESC0603(1608)_L]  (hidden comment: 560 0603)
R354  value 560  [RESC0603(1608)_L]  (hidden comment: 560 0603)
R355  value 560  [RESC0603(1608)_L]  (hidden comment: 560 0603)
R356  value 560  [RESC0603(1608)_L]  (hidden comment: 560 0603)
R357  value 560  [RESC0603(1608)_L]  (hidden comment: 560 0603)
R358  value 560  [RESC0603(1608)_L]  (hidden comment: 560 0603)
R359  value 560  [RESC0603(1608)_L]  (hidden comment: 560 0603)
R360  value 560  [RESC0603(1608)_L]  (hidden comment: 560 0603)
R361  237  [RESC0603(1608)_L]
R362  237  [RESC0603(1608)_L]
R363  237  [RESC0603(1608)_L]
R364  237  [RESC0603(1608)_L]
R365  237  [RESC0603(1608)_L]
R366  237  [RESC0603(1608)_L]
R367  237  [RESC0603(1608)_L]
R368  237  [RESC0603(1608)_L]
R369  value 49.9k  [RESC0603(1608)_L]  (hidden comment: 49.9k Ohm 0603)
R370  value 49.9k  [RESC0603(1608)_L]  (hidden comment: 49.9k Ohm 0603)
R371  value 49.9k  [RESC0603(1608)_L]  (hidden comment: 49.9k Ohm 0603)
R372  value 49.9k  [RESC0603(1608)_L]  (hidden comment: 49.9k Ohm 0603)
R373  value 49.9k  [RESC0603(1608)_L]  (hidden comment: 49.9k Ohm 0603)
R374  value 49.9k  [RESC0603(1608)_L]  (hidden comment: 49.9k Ohm 0603)
R375  value 49.9k  [RESC0603(1608)_L]  (hidden comment: 49.9k Ohm 0603)
R376  value 49.9k  [RESC0603(1608)_L]  (hidden comment: 49.9k Ohm 0603)
R377  value 6.6k  [RESC0603(1608)_L]  (hidden comment: 6.6k 0603)
R378  value 6.6k  [RESC0603(1608)_L]  (hidden comment: 6.6k 0603)
R379  value 6.6k  [RESC0603(1608)_L]  (hidden comment: 6.6k 0603)
R380  value 6.6k  [RESC0603(1608)_L]  (hidden comment: 6.6k 0603)
R381  value 6.6k  [RESC0603(1608)_L]  (hidden comment: 6.6k 0603)
R382  value 6.6k  [RESC0603(1608)_L]  (hidden comment: 6.6k 0603)
R383  value 6.6k  [RESC0603(1608)_L]  (hidden comment: 6.6k 0603)
R384  value 6.6k  [RESC0603(1608)_L]  (hidden comment: 6.6k 0603)
R385  value 1k  [RESC0603(1608)_L]  (hidden comment: 1k 0603)
R386  value 1k  [RESC0603(1608)_L]  (hidden comment: 1k 0603)
R387  value 1k  [RESC0603(1608)_L]  (hidden comment: 1k 0603)
R388  value 1k  [RESC0603(1608)_L]  (hidden comment: 1k 0603)
R389  value 2k  [RESC0603(1608)_L]  (hidden comment: 2k 0603)
R390  value 2k  [RESC0603(1608)_L]  (hidden comment: 2k 0603)
R391  value 2k  [RESC0603(1608)_L]  (hidden comment: 2k 0603)
R392  value 2k  [RESC0603(1608)_L]  (hidden comment: 2k 0603)
R393  value 1k  [RESC0603(1608)_L]  (hidden comment: 1k 0603)
R394  value 1k  [RESC0603(1608)_L]  (hidden comment: 1k 0603)
R395  value 1k  [RESC0603(1608)_L]  (hidden comment: 1k 0603)
R396  value 1k  [RESC0603(1608)_L]  (hidden comment: 1k 0603)
R397  value 2k  [RESC0603(1608)_L]  (hidden comment: 2k 0603)
R398  value 2k  [RESC0603(1608)_L]  (hidden comment: 2k 0603)
R399  value 2k  [RESC0603(1608)_L]  (hidden comment: 2k 0603)
R400  value 2k  [RESC0603(1608)_L]  (hidden comment: 2k 0603)
R401  value 560  [RESC0603(1608)_L]  (hidden comment: 560 0603)
R402  value 560  [RESC0603(1608)_L]  (hidden comment: 560 0603)
R403  value 560  [RESC0603(1608)_L]  (hidden comment: 560 0603)
R404  value 560  [RESC0603(1608)_L]  (hidden comment: 560 0603)
R405  value 560  [RESC0603(1608)_L]  (hidden comment: 560 0603)
R406  value 560  [RESC0603(1608)_L]  (hidden comment: 560 0603)
R407  value 560  [RESC0603(1608)_L]  (hidden comment: 560 0603)
R408  value 560  [RESC0603(1608)_L]  (hidden comment: 560 0603)
U8  TL074CDR  [D0014A_N]  (parts A,B,C,D of 4)
U9  TL074CDR  [D0014A_N]  (parts A,B,C,D of 4)
U10  TL074CDR  [D0014A_N]  (parts A,B,C,D of 4)
U11  TL074CDR  [D0014A_N]  (parts A,B,C,D of 4)
U12  TL074CDR  [D0014A_N]  (parts A,B,C,D of 4)
U13  TL074CDR  [D0014A_N]  (parts A,B,C,D of 4)
U14  TL074CDR  [D0014A_N]  (parts A,B,C,D of 4)
U15  TL074CDR  [D0014A_N]  (parts A,B,C,D of 4)

## Ports
+Amp (in, see Amps[1A], Amps[1B], Amps[1C], Amps[1D], Amps[2A], Amps[2B], Amps[2C], Amps[2D], Amps[3A], Amps[3B], Amps[3C], Amps[3D], Amps[4A], Amps[4B], Amps[4C], Amps[4D], Amps[5A], Amps[5B], Amps[5C], Amps[5D], Amps[6A], Amps[6B], Amps[6C], Amps[6D], IO[1B], IO[2B], IO[5A], IO[5B], NUCLEO[2C]), -Amp (in, see Amps[1A], Amps[1B], Amps[1C], Amps[1D], Amps[2A], Amps[2B], Amps[2C], Amps[2D], Amps[3A], Amps[3B], Amps[3C], Amps[3D], Amps[4A], Amps[4B], Amps[4C], Amps[4D], Amps[5A], Amps[5B], Amps[5C], Amps[5D], Amps[6A], Amps[6B], Amps[6C], Amps[6D], IO[1B], IO[3B], IO[5A], IO[5B]), DAC1N (in, see DAC[3B]), DAC1P (in, see DAC[3B]), DAC2N (in, see DAC[3B]), DAC2P (in, see DAC[3B]), DAC3N (in, see DAC[3B]), DAC3P (in, see DAC[3B]), DAC4N (in, see DAC[3B]), DAC4P (in, see DAC[3B]), DAC5N (in, see DAC[2A]), DAC5P (in, see DAC[2A]), DAC6N (in, see DAC[2A]), DAC6P (in, see DAC[2A]), DAC7N (in, see DAC[2A]), DAC7P (in, see DAC[2A]), DAC8N (in, see DAC[2A]), DAC8P (in, see DAC[2A]), DAC9N (in, see DAC[2A]), DAC9P (in, see DAC[2A]), DAC10N (in, see DAC[2A]), DAC10P (in, see DAC[2A]), DAC11N (in, see DAC[2A]), DAC11P (in, see DAC[2A]), DAC12N (in, see DAC[2A]), DAC12P (in, see DAC[2A]), DAC13N (in, see DAC[1B]), DAC13P (in, see DAC[1B]), DAC14N (in, see DAC[1B]), DAC14P (in, see DAC[1B]), DAC15N (in, see DAC[1B]), DAC15P (in, see DAC[1B]), DAC16N (in, see DAC[1B]), DAC16P (in, see DAC[1B]), DAC17N (in, see DAC[5B]), DAC17P (in, see DAC[5B]), DAC18N (in, see DAC[5B]), DAC18P (in, see DAC[5B]), DAC19N (in, see DAC[5B]), DAC19P (in, see DAC[5B]), DAC20N (in, see DAC[5B]), DAC20P (in, see DAC[5B]), DAC21N (in, see DAC[5A]), DAC21P (in, see DAC[5A]), DAC22N (in, see DAC[5A]), DAC22P (in, see DAC[5A]), DAC23N (in, see DAC[5A]), DAC23P (in, see DAC[5A]), DAC24N (in, see DAC[5A]), DAC24P (in, see DAC[5A]), DAC25N (in, see DAC[5A]), DAC25P (in, see DAC[5A]), DAC26N (in, see DAC[5A]), DAC26P (in, see DAC[5A]), DAC27N (in, see DAC[5A]), DAC27P (in, see DAC[5A]), DAC28N (in, see DAC[5A]), DAC28P (in, see DAC[5A]), DAC29N (in, see DAC[4B]), DAC29P (in, see DAC[4B]), DAC30N (in, see DAC[4B]), DAC30P (in, see DAC[4B]), DAC31N (in, see DAC[4B]), DAC31P (in, see DAC[4B]), DAC32N (in, see DAC[4B]), DAC32P (in, see DAC[4B]), OUT1P (out, see IO[1C]), OUT2P (out, see IO[1C]), OUT3P (out, see IO[1C]), OUT4P (out, see IO[1D]), OUT5P (out, see IO[2C]), OUT6P (out, see IO[2C]), OUT7P (out, see IO[2C]), OUT8P (out, see IO[2D]), OUT9P (out, see IO[2C]), OUT10P (out, see IO[2C]), OUT11P (out, see IO[2C]), OUT12P (out, see IO[2D]), OUT13P (out, see IO[3C]), OUT14P (out, see IO[3C]), OUT15P (out, see IO[3C]), OUT16P (out, see IO[3D]), OUT17P (out, see IO[4C]), OUT18P (out, see IO[4C]), OUT19P (out, see IO[4C]), OUT20P (out, see IO[4D]), OUT21P (out, see IO[4C]), OUT22P (out, see IO[4C]), OUT23P (out, see IO[4C]), OUT24P (out, see IO[4D]), OUT25P (out, see IO[5C]), OUT26P (out, see IO[5C]), OUT27P (out, see IO[5C]), OUT28P (out, see IO[5D]), OUT29P (out, see IO[6C]), OUT30P (out, see IO[6C]), OUT31P (out, see IO[6C]), OUT32P (out, see IO[6D])